# EasyEDA Pro project Access Control Core.eprj, board RGB Screen
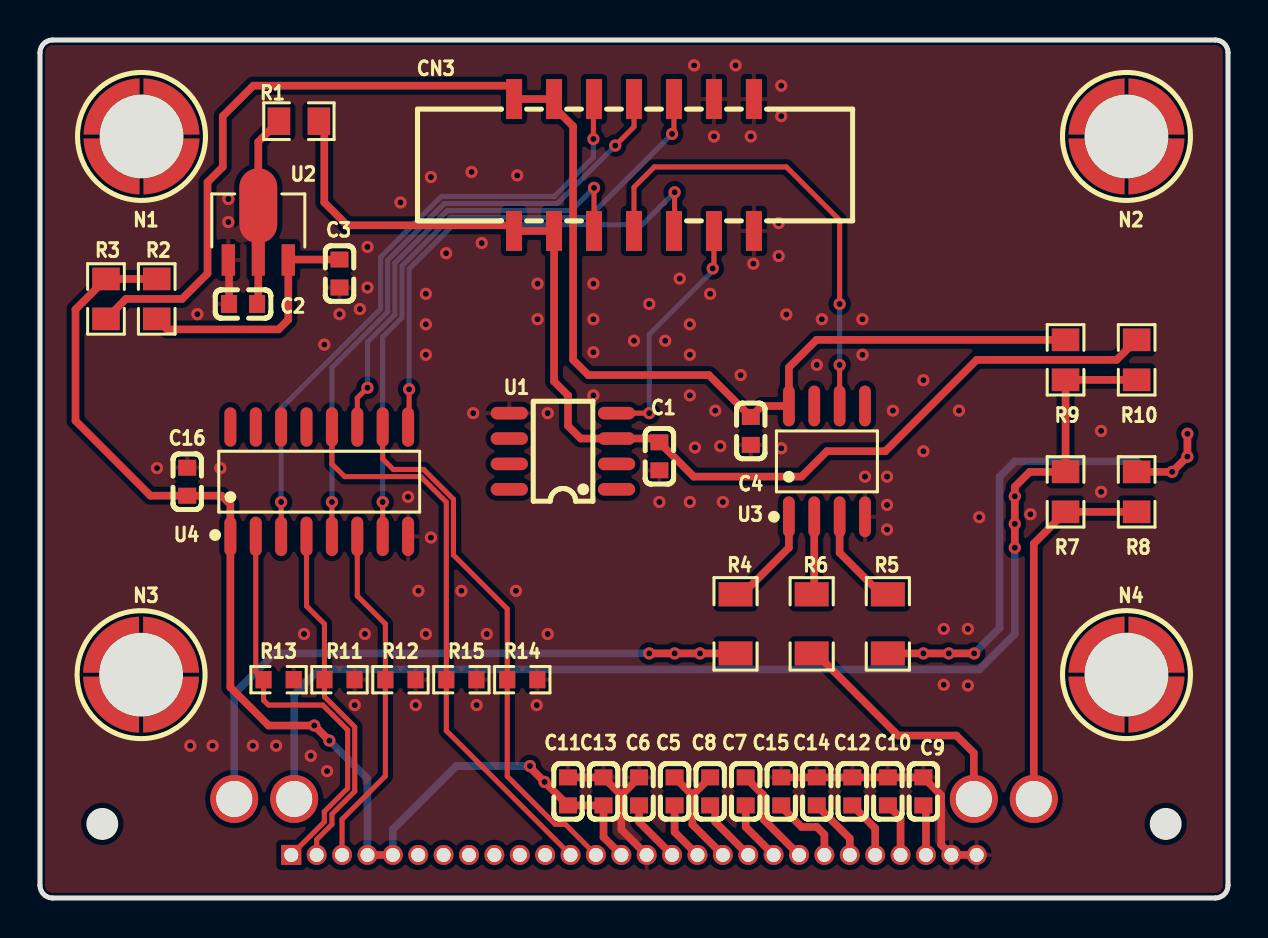
[diagram p13: board, top side]
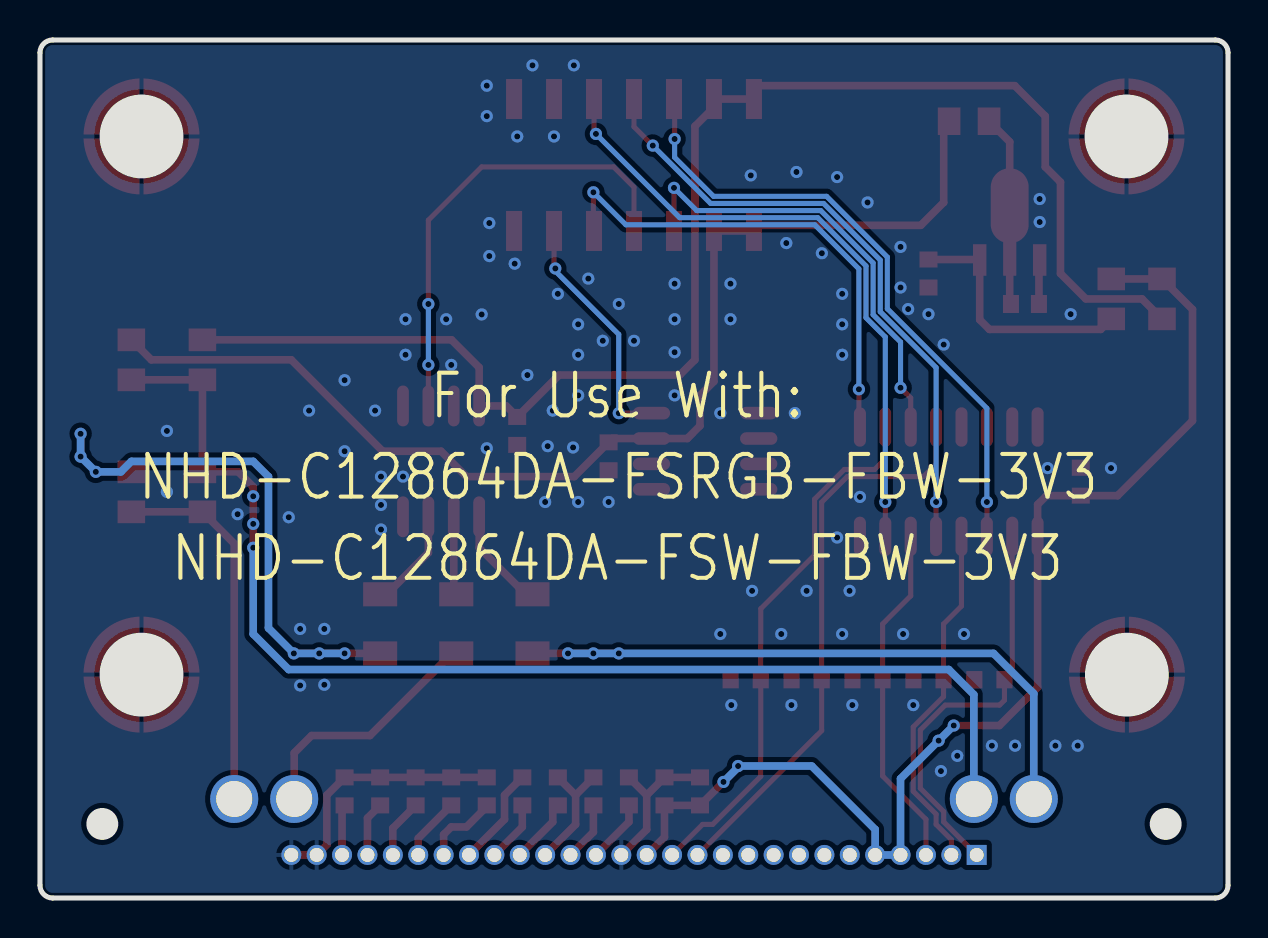
[diagram p14: board, bottom side, seen from below]

Outline 59.44 x 42.93 mm; copper layers: Top Layer, Bottom Layer. Coordinates in mm from the lower left corner of the outline.
Outline path: 0,42.29 0,0.63 arc(0.19,0.19) 0.64,0 58.8,0 arc(59.25,0.19) 59.44,0.63 59.44,42.29 arc(59.25,42.74) 58.8,42.93 0.64,42.93 arc(0.19,42.74) 0,42.29
Stack: Top Layer 0.035mm / Dielectric1 1.51mm FR4 er 4.5 / Bottom Layer 0.035mm

## Design rules (mm)
template: JLCPCB Capability(Two Layers Board)
spacing copperThickness1oz (default): track to track 0.102, other pairs 0.152 to 0.3
spacing copperThickness2oz: track to track 0.203, other pairs 0.152 to 0.3
track width copperThickness1oz (default): min 0.127, default 0.254, max 2.54
track width copperThickness2oz: min 0.203, default 0.254, max 2.54
differential pair differentialPair (default): width min 0.127, default 0.254, max 2.54; gap min 0.152, default 0.152
via viaSize (default): diameter min 0.5, default 0.61, max 10; hole min 0.3, default 0.305, max 6.3

## Placement (name value [footprint] x y rotation side)
C1  100nF  [C0603]  30.99 22.1 90 top
C2  1uF  [C0603]  10.16 29.72 0 top
C3  1uF  [C0603]  14.99 31.24 90 top
C4  100nF  [C0603]  35.56 23.37 90 top
C5  2.2uF  [C0603]  31.75 5.33 90 top
C6  2.2uF  [C0603]  29.97 5.33 90 top
C7  2.2uF  [C0603]  35.31 5.33 90 top
C8  2.2uF  [C0603]  33.53 5.33 270 top
C9  1uF  [C0603]  44.2 5.33 270 top
C10  1uF  [C0603]  42.42 5.33 270 top
C11  2.2uF  [C0603]  26.42 5.33 90 top
C12  1uF  [C0603]  40.64 5.33 270 top
C13  1uF  [C0603]  28.19 5.33 270 top
C14  1uF  [C0603]  38.86 5.33 270 top
C15  1uF  [C0603]  37.08 5.33 270 top
C16  100nF  [C0603]  7.37 20.83 270 top
CN3  B-3002N14P-0110  [IDC-SMD_14P-P2.00_B-3002N14P-0110]  29.72 36.67 0 top
N1  SMTSO3040CTJ  [SMD-1_BD5.5-D4.0_H4.0]  5.08 38.1 0 top
N2  SMTSO3040CTJ  [SMD-1_BD5.5-D4.0_H4.0]  54.36 38.1 0 top
N3  SMTSO3040CTJ  [SMD-1_BD5.5-D4.0_H4.0]  5.06 11.17 0 top
N4  SMTSO3040CTJ  [SMD-1_BD5.5-D4.0_H4.0]  54.36 11.18 0 top
R1  0Ω  [R0805]  12.95 38.86 180 top
R2  0Ω  [R0805]  5.84 29.97 90 top
R3  0Ω  [R0805]  3.3 29.97 90 top
R4  20Ω  [R1206]  34.8 13.72 90 top
R5  20Ω  [R1206]  42.42 13.72 90 top
R6  20Ω  [R1206]  38.61 13.72 90 top
R7  0Ω  [R0805]  51.31 20.32 90 top
R8  0Ω  [R0805]  54.86 20.32 90 top
R9  0Ω  [R0805]  51.31 26.92 90 top
R10  0Ω  [R0805]  54.86 26.92 90 top
R11  10kΩ  [R0603]  14.99 10.92 180 top
R12  10kΩ  [R0603]  18.03 10.92 180 top
R13  10kΩ  [R0603]  11.94 10.92 180 top
R14  10kΩ  [R0603]  24.13 10.92 180 top
R15  10kΩ  [R0603]  21.08 10.92 180 top
U1  DS18B20Z  [SOP-8_L4.9-W3.9-P1.27-LS6.0-BL]  26.16 22.35 90 top
U2  AP7380-30Y-13  [SOT-89-3_L4.5-W2.5-P1.50-LS4.2-BR]  10.92 33.27 270 top
U3  TLC59731DR  [SOIC-8_L4.9-W3.8-P1.27-LS6.0-BL]  39.37 21.84 0 top
U4  CD74HC4050M96  [SOIC-16_L9.9-W3.9-P1.27-LS6.0-BL]  13.97 20.83 0 top
U5  NHD-C12864DA-FSRGB-FBW-3V3  [LCD-TH_L58.2-W41.7-P1.27_NHD-C12864DA-FSRGB-FBW-3V3]  29.72 3.56 180 bottom

## Footprints (pads in the part's own frame, mm; a bottom-side part is the same pattern mirrored in y, then rotated)
C0603
  rect 0.8x0.9 smd: 1(-0.7,0) 2(0.7,0)
IDC-SMD_14P-P2.00_B-3002N14P-0110
  rect 0.8x2 smd: 1(-6,-3.3) 2(-6,3.3) 3(-4,-3.3) 4(-4,3.3) 5(-2,-3.3) 6(-2,3.3) 7(0,-3.3) 8(0,3.3) 9(2,-3.3) 10(2,3.3) 11(4,-3.3) 12(4,3.3) 13(6,-3.3) 14(6,3.3)
LCD-TH_L58.2-W41.7-P1.27_NHD-C12864DA-FSRGB-FBW-3V3
  rect 1x1 hole 0.7: 1(17.145,-1.4)
  round 1 hole 0.7: 2(15.875,-1.4) 3(14.605,-1.4) 4(13.335,-1.4) 5(12.065,-1.4) 6(10.795,-1.4) 7(9.525,-1.4) 8(8.255,-1.4) 9(6.985,-1.4) 10(5.715,-1.4) 11(4.445,-1.4) 12(3.175,-1.4) 13(1.905,-1.4) 14(0.635,-1.4) 15(-0.635,-1.4) 16(-1.905,-1.4) 17(-3.175,-1.4) 18(-4.445,-1.4) 19(-5.715,-1.4) 20(-6.985,-1.4) 21(-8.255,-1.4) 22(-9.525,-1.4) 23(-10.795,-1.4) 24(-12.065,-1.4) 25(-13.335,-1.4) 26(-14.605,-1.4) 27(-15.875,-1.4) 28(-17.145,-1.4)
  round 2.4 hole 1.8: 29(-17,1.4) 30(17,1.4) 31(-20,1.4) 32(20,1.4)
R0603
  rect 0.806x0.864 smd: 1(-0.753,0) 2(0.753,0)
R0805
  rect 1.133x1.377 smd: 1(-1,0) 2(1,0)
R1206
  rect 1.208x1.701 smd: 1(-1.479,0) 2(1.479,0)
SMD-1_BD5.5-D4.0_H4.0
  custom 2.8x2.8 smd: 1(-1.5,1.5) 1(-1.5,-1.5) 1(1.5,1.5) 1(1.5,-1.5)
SOIC-8_L4.9-W3.8-P1.27-LS6.0-BL
  oval 0.588x2.045 smd: 1(-1.905,-2.772) 2(-0.635,-2.772) 3(0.635,-2.772) 4(1.905,-2.772) 5(1.905,2.772) 6(0.635,2.772) 7(-0.635,2.772) 8(-1.905,2.772)
SOIC-16_L9.9-W3.9-P1.27-LS6.0-BL
  oval 0.602x1.971 smd: 1(-4.445,-2.736) 2(-3.175,-2.736) 3(-1.905,-2.736) 4(-0.635,-2.736) 5(0.635,-2.736) 6(1.905,-2.736) 7(3.175,-2.736) 8(4.445,-2.736) 9(4.445,2.736) 10(3.175,2.736) 11(1.905,2.736) 12(0.635,2.736) 13(-0.635,2.736) 14(-1.905,2.736) 15(-3.175,2.736) 16(-4.445,2.736)
SOP-8_L4.9-W3.9-P1.27-LS6.0-BL
  oval 0.63x1.865 smd: 1(-1.905,-2.683) 2(-0.635,-2.683) 3(0.635,-2.683) 4(1.905,-2.683) 5(1.905,2.683) 6(0.635,2.683) 7(-0.635,2.683) 8(-1.905,2.683)
SOT-89-3_L4.5-W2.5-P1.50-LS4.2-BR
  rect 1.575x0.672 smd: 1(1.356,-1.5) 3(1.356,1.5)
  custom 5.377x1.9 smd: 2(-1.356,0)

## Nets
As in the schematic.

Pads without a net: N1 1; N2 1; N3 1; N4 1; U1 1 2 6 7 8; U3 5 7; U4 13 15 16; U5 6 7 8 9 10 11

## Via types
v1: diameter 0.61, hole 0.305, Top Layer to Bottom Layer, 123 vias

## Routing (per net, layer and track width the routed paths; a pad name or vN(x,y) marks a point on that pad's centre or on a via; arc(x,y) is an arc through that point)
+3.0V: length 12.6
  Top Layer w0.381: R2.1 6.37,28.45 11.94,28.45 12.42,28.93 U2.3 12.45,31.94 C3.2
+3.3V: length 74
  Top Layer w0.381: R9.2 38.85,27.92 37.47,26.54 U3.8 36.11,24.62 C4.2 33.47,26.16 27.43,26.16 26.67,26.92 26.67,38.61 25.72,39.56 CN3.4 CN3.2 23.72,40.54 23.62,40.64 10.67,40.64 9.14,39.12 9.14,36.58 8.38,35.81 8.38,31.24 7.11,29.97 4.3,29.97 R3.1
+5V: length 58.6
  Top Layer w0.381: R1.1 14.22,38.59 14.22,34.8 15.37,33.66 23.43,33.66 CN3.1 CN3.3 25.72,25.84 26.42,25.15 26.42,23.62 27.05,22.99 U1.3 30.8,22.99 C1.2 32.7,21.08 38.1,21.08 39.37,22.35 42.29,22.35 46.86,26.92 53.86,26.92 R10.2
GND: length 22.9
  Top Layer w0.381: C11.2 C13.1 29.08,5.14 ; 29.08,5.14 C6.2 ; 29.08,5.14 29.08,3.43 U5.15 ; C15.1 C14.1 C12.1 C10.1 C9.1 45.09,5.14 45.09,2.66 U5.27 U5.28 ; C2.1 9.46,31.88 U2.1
  vias: v1(5.86,21.51) v1(7.52,7.62) v1(7.87,29.21) v1(8.64,7.62) v1(9.02,21.51) v1(9.42,34.97) v1(9.42,33.82) v1(10.65,7.62) v1(11.81,7.62) v1(13.21,13.21) v1(13.55,7.11) v1(14.22,27.69) v1(14.36,6.35) v1(14.99,29.21) v1(15.75,9.65) v1(16,29.46) v1(16.26,13.21) v1(16.38,32.57) v1(16.38,30.54) v1(18.03,34.8) v1(18.42,20.07) v1(18.8,9.65) v1(18.93,15.37) v1(19.3,30.23) v1(19.3,28.7) v1(19.3,27.18) v1(19.3,13.21) v1(19.56,36.07) v1(19.56,18.03) v1(20.32,32.26) v1(21.08,15.37) v1(21.59,36.32) v1(21.67,24.26) v1(21.84,9.65) v1(22.1,32.77) v1(22.35,13.21) v1(23.88,36.15) v1(23.81,15.37) v1(24.85,9.65) v1(24.89,30.73) v1(24.89,28.96) v1(25.4,24.26) v1(25.4,13.21) v1(27.69,30.73) v1(27.69,28.96) v1(27.69,27.31) v1(27.69,25.15) v1(29.72,27.88) v1(30.48,29.72) v1(30.99,19.81) v1(31.28,27.88) v1(32,30.99) v1(32.51,28.7) v1(32.51,27.18) v1(32.51,25.15) v1(32.51,19.81) v1(32.73,41.66) v1(32.77,22.54) v1(33.53,30.23) v1(33.72,38.1) v1(33.78,24.38) v1(34.04,22.61) v1(34.16,19.81) v1(34.8,41.66) v1(35.05,26.16) v1(35.56,38.1) v1(35.69,31.73) v1(36.96,33.77) v1(36.96,32.12) v1(37.08,40.64) v1(37.08,39.12) v1(37.08,22.5) v1(37.34,29.19) v1(38.86,26.67) v1(39.12,28.96) v1(41.15,28.96) v1(41.15,27.18) v1(41.28,21.08) v1(42.38,21.08) v1(42.38,19.66) v1(42.38,18.44) v1(42.67,24.38) v1(44.2,25.91) v1(44.2,22.35) v1(45.21,13.46) v1(45.21,10.67) v1(45.97,24.38) v1(46.42,13.46) v1(46.42,10.63) v1(46.99,19.05) v1(49.55,19.2) v1(53.09,23.37) v1(53.09,20.32)
V0: length 2.5
  Top Layer w0.381: U5.26 44.32,4.51 C9.2
V1: length 2.7
  Top Layer w0.381: C10.2 43.05,4 43.05,2.16
V2: length 3
  Top Layer w0.381: U5.24 41.78,3.49 C12.2
V3: length 3.2
  Top Layer w0.381: U5.23 40.51,2.98 C14.2
V4: length 3.8
  Top Layer w0.381: U5.22 39.24,3.17 38.86,3.56 38.1,3.56 37.08,4.57 C15.2
VCC: length 63
  Top Layer w0.381: R2.2 R3.2 1.78,29.45 1.78,23.88 5.53,20.13 C16.2 9.08,20.13 9.53,19.69 U4.1 9.53,10.54 11.44,8.63 v1(13.72,8.63) v1(14.48,7.87) ; v1(24.51,6.6) 24.51,6.54 v1(25.24,5.81) C11.1 C13.2 28.19,3.05 U5.14 ; U5.4 U5.5
  Bottom Layer w0.381: v1(25.24,5.81) 24.51,6.54 v1(24.51,6.6) 20.83,6.6 17.65,3.43 U5.5 U5.4 16.38,5.97 v1(14.48,7.87) v1(13.72,8.63)
CAP1N: length 6.1
  Top Layer w0.381: U5.18 32.64,3.68 32.64,5.14 ; 32.64,5.14 C8.1 ; 32.64,5.14 C5.2
CAP1P: length 3.3
  Top Layer w0.381: C8.2 33.78,4.38 33.78,3.81 U5.19
CAP2N: length 5
  Top Layer w0.381: C7.2 36.19,5.14 36.19,3.93 U5.21
CAP2P: length 3.1
  Top Layer w0.381: U5.20 35.31,3.55 C7.1
CAP3P: length 3
  Top Layer w0.381: 32.89,2.16 31.75,3.3 C5.1
GPIO1: length 22.7
  Top Layer w0.254: v1(27.72,35.53) CN3.5 ; U4.11 15.88,25.02 v1(16.38,25.53)
  Bottom Layer w0.254: v1(16.38,25.53) 16.38,27.81 17.75,29.19 17.75,31.77 20.38,34.39 26.58,34.39 v1(27.72,35.53)
GPIO2: length 23.3
  Top Layer w0.254: v1(40,29.72) 40,33.91 37.34,36.58 30.73,36.58 29.72,35.56 CN3.7 ; U3.6 v1(40,26.67)
  Bottom Layer w0.254: v1(40,26.67) v1(40,29.72)
GPIO3: length 24.8
  Top Layer w0.254: 18.42,23.56 18.47,23.62 v1(18.47,25.45) ; v1(31.75,35.31) 31.75,33.4 CN3.9
  Bottom Layer w0.254: v1(18.47,25.45) 18.47,31.48 20.67,33.68 30.12,33.68 v1(31.75,35.31)
GPIO4: length 31.7
  Top Layer w0.254: v1(27.69,37.97) 27.69,39.94 CN3.6 ; v1(12.06,19.81) U4.3
  Bottom Layer w0.254: v1(12.06,19.81) 12.06,24.5 17.04,29.48 17.04,32.07 20.08,35.1 25.74,35.1 27.69,37.05 v1(27.69,37.97)
GPIO5: length 31.5
  Top Layer w0.254: v1(28.78,37.64) 29.72,38.58 CN3.8 ; v1(14.61,19.81) U4.5
  Bottom Layer w0.254: v1(28.78,37.64) 25.88,34.75 20.23,34.75 17.4,31.92 17.4,29.33 14.61,26.54 v1(14.61,19.81)
GPIO6: length 32
  Top Layer w0.254: CN3.10 31.72,38.32 v1(31.62,38.23) ; v1(17.15,19.81) U4.7
  Bottom Layer w0.254: v1(17.15,19.81) 17.15,28.07 18.11,29.03 18.11,31.62 20.52,34.04 27.43,34.04 v1(31.62,38.23)
GREEN-PIN: length 18.6
  Top Layer w0.381: U5.31 49.72,17.73 R7.1 R8.1
K-BLUE: length 12.5
  Top Layer w0.381: R6.1 38.82,12.24 42.93,8.13 45.85,8.13 46.72,7.26 U5.29
K-GREEN: length 31.1
  Top Layer w0.381: v1(57.4,23.22) v1(57.4,22.08) v1(56.64,21.32) R8.2 ; v1(46.74,12.24) v1(45.47,12.24) v1(44.2,12.24) R5.1
  Bottom Layer w0.381: v1(57.4,23.22) v1(57.4,22.08) v1(56.64,21.32) 55.39,21.32 54.86,21.84 48.77,21.84 48.01,21.08 48.01,13.51 v1(46.74,12.24) 45.72,12.24 ; 44.45,12.24 v1(45.47,12.24)
K-RED: length 33.7
  Top Layer w0.381: R4.1 v1(33.02,12.24) v1(31.75,12.24) v1(30.48,12.24)
  Bottom Layer w0.381: U5.32 9.72,10.23 11.73,12.24 v1(30.48,12.24) v1(31.75,12.24) v1(33.02,12.24)
ONEWIRE: length 12.1
  Top Layer w0.254: v1(33.66,31.5) 33.72,31.56 CN3.11 ; U1.4 v1(30.48,24.26)
  Bottom Layer w0.254: v1(30.48,24.26) 30.48,28.19 33.66,31.37 v1(33.66,31.5)
SCREEN-A0: length 17.4
  Top Layer w0.254: 15.11,2.16 15.11,3.94 17.28,6.1 R12.2 17.28,13.71 15.88,15.11 U4.6
SCREEN-CS1B: length 20.6
  Top Layer w0.254: U5.1 14.22,3.81 14.22,4.32 15.39,5.49 15.39,8.41 14.15,9.65 11.43,9.65 11.18,9.9 R13.2 10.8,11.31 10.8,18.09
SCREEN-MOSI: length 27
  Top Layer w0.254: U5.13 26.29,3.68 25.78,3.68 23.38,6.09 R14.2 23.38,14.47 20.68,17.16 20.68,19.95 19.2,21.44 17.68,21.44 17.15,21.97 U4.10
SCREEN-RESET: length 17.7
  Top Layer w0.254: U5.2 13.84,2.92 14.61,3.68 14.61,4.2 15.75,5.34 15.75,8.56 14.23,10.07 R11.2 14.23,13.71 13.34,14.61 U4.4
SCREEN-SCK: length 28.6
  Top Layer w0.254: U5.12 20.33,8.37 R15.2 20.33,19.8 19.05,21.08 15.24,21.08 14.61,21.72 U4.12
VANODE: length 60.9
  Top Layer w0.381: R10.1 R9.1 R7.2 49.51,21.32 48.77,20.57 v1(48.77,20.1) v1(48.77,18.72) v1(48.77,17.53)
  Bottom Layer w0.381: U5.30 12.72,10.18 13.97,11.43 46.99,11.43 48.77,13.21 v1(48.77,17.53)
VOUT: length 3.2
  Top Layer w0.381: U5.16 29.97,3.81 C6.1
$1N6241: length 9.6
  Top Layer w0.381: R1.2 10.92,37.83 U2.2 10.92,29.78 C2.2
$2N1559: length 5.1
  Top Layer w0.381: U3.3 40,17.27 42.08,15.19 R5.2
$2N1563: length 3.9
  Top Layer w0.381: R6.2 38.74,15.32 U3.2
$2N1570: length 5.2
  Top Layer w0.381: R4.2 35.13,15.19 37.47,17.53 U3.1

## Copper pours and planes (outline as drawn; the poured copper is in the pictures)
GND on Top Layer: -2.03,45.72 60.96,45.72 60.96,-3.81 -2.03,-3.81
GND on Bottom Layer: -2.03,44.7 60.71,44.7 60.71,-3.56 -2.03,-3.56

## Text on the board
Bottom Silkscreen Layer: For Use With: | NHD-C12864DA-FSW-FBW-3V3 | NHD-C12864DA-FSRGB-FBW-3V3
